# Altium schematic sheet FPGA_IOs.SchDoc (continued)
## Nets (continued)
CFG_DIFFI15_P: D2.G12(IO,_(DIFFIO_RX_T31p,_DIFFOUT_T31p,_DQ4T,_DQ2T)) ; port CFG_DIFF_I_BUS.CFG_DIFFI_p15
CFG_DIFFI16_N: D2.K8(IO,_(DIFFIO_RX_T33n,_DIFFOUT_T33n)) ; port CFG_DIFF_I_BUS.CFG_DIFFI_n16
CFG_DIFFI16_P: D2.K7(IO,_(DIFFIO_RX_T33p,_DIFFOUT_T33p)) ; port CFG_DIFF_I_BUS.CFG_DIFFI_p16
CFG_DIFFI17_N: D2.F10(IO,_(DIFFIO_RX_T35n,_DIFFOUT_T35n,_DQ5T,_DQ2T)) ; port CFG_DIFF_I_BUS.CFG_DIFFI_n17
CFG_DIFFI17_P: D2.G10(IO,_(DIFFIO_RX_T35p,_DIFFOUT_T35p,_DQ5T,_DQ2T)) ; port CFG_DIFF_I_BUS.CFG_DIFFI_p17
CFG_DIFFI18_N: D2.J9(IO,_(DIFFIO_RX_T37n,_DIFFOUT_T37n,_DQSn5T,_DQ2T)) ; port CFG_DIFF_I_BUS.CFG_DIFFI_n18
CFG_DIFFI18_P: D2.J10(IO,_(DIFFIO_RX_T37p,_DIFFOUT_T37p,_DQS5T,_DQ2T)) ; port CFG_DIFF_I_BUS.CFG_DIFFI_p18
CFG_DIFFI19_N: D2.F8(IO,_(DIFFIO_RX_T39n,_DIFFOUT_T39n,_DQ5T,_DQ2T)) ; port CFG_DIFF_I_BUS.CFG_DIFFI_n19
CFG_DIFFI19_P: D2.F9(IO,_(DIFFIO_RX_T39p,_DIFFOUT_T39p,_DQ5T,_DQ2T)) ; port CFG_DIFF_I_BUS.CFG_DIFFI_p19
CFG_DIFFI_CKI0_N: D2.G15(IO,_CLK7n,_(DIFFIO_RX_T1n,_DIFFOUT_T1n)) ; port CFG_DIFF_I_BUS.CFG_DIFFI_n0
CFG_DIFFI_CKI0_P: D2.H15(IO,_CLK7p,_(DIFFIO_RX_T1p,_DIFFOUT_T1p)) ; port CFG_DIFF_I_BUS.CFG_DIFFI_p0
CFG_DIFFI_CKI4_N: D2.J14(IO,_CLK6n,_FPLL_TL_FBn,_(DIFFIO_RX_T9n,_DIFFOUT_T9n)) ; port CFG_DIFF_I_BUS.CFG_DIFFI_n4
CFG_DIFFI_CKI4_P: D2.K14(IO,_CLK6p,_FPLL_TL_FBp,_(DIFFIO_RX_T9p,_DIFFOUT_T9p)) ; port CFG_DIFF_I_BUS.CFG_DIFFI_p4
CFG_DIFFO0_N: D2.A13(IO,_(DIFFIO_TX_T2n,_DIFFOUT_T2n,_DQ1T)) ; port CFG_DIFF_O_BUS.CFG_DIFFO_n0
CFG_DIFFO0_P: D2.B13(IO,_(DIFFIO_TX_T2p,_DIFFOUT_T2p,_DQ1T)) ; port CFG_DIFF_O_BUS.CFG_DIFFO_p0
CFG_DIFFO2_N: D2.B11(IO,_(DIFFIO_TX_T6n,_DIFFOUT_T6n,_DQ1T)) ; port CFG_DIFF_O_BUS.CFG_DIFFO_n2
CFG_DIFFO2_P: D2.C12(IO,_(DIFFIO_TX_T6p,_DIFFOUT_T6p)) ; port CFG_DIFF_O_BUS.CFG_DIFFO_p2
CFG_DIFFO3_N: D2.A8(IO,_(DIFFIO_TX_T8n,_DIFFOUT_T8n)) ; port CFG_DIFF_O_BUS.CFG_DIFFO_n3
CFG_DIFFO3_P: D2.A9(IO,_(DIFFIO_TX_T8p,_DIFFOUT_T8p,_DQ1T)) ; port CFG_DIFF_O_BUS.CFG_DIFFO_p3
CFG_DIFFO4_N: D2.B7(IO,_(DIFFIO_TX_T10n,_DIFFOUT_T10n,_DQ2T,_DQ1T)) ; port CFG_DIFF_O_BUS.CFG_DIFFO_n4
CFG_DIFFO4_P: D2.C7(IO,_(DIFFIO_TX_T10p,_DIFFOUT_T10p,_DQ2T,_DQ1T)) ; port CFG_DIFF_O_BUS.CFG_DIFFO_p4
CFG_DIFFO5_N: D2.B8(IO,_(DIFFIO_TX_T12n,_DIFFOUT_T12n,_DQ2T,_DQ1T)) ; port CFG_DIFF_O_BUS.CFG_DIFFO_n5
CFG_DIFFO5_P: D2.C8(IO,_(DIFFIO_TX_T12p,_DIFFOUT_T12p,_DQ2T,_DQ1T)) ; port CFG_DIFF_O_BUS.CFG_DIFFO_p5
CFG_DIFFO6_N: D2.C9(IO,_(DIFFIO_TX_T14n,_DIFFOUT_T14n,_DQ2T,_DQ1T)) ; port CFG_DIFF_O_BUS.CFG_DIFFO_n6
CFG_DIFFO6_P: D2.C10(IO,_(DIFFIO_TX_T14p,_DIFFOUT_T14p)) ; port CFG_DIFF_O_BUS.CFG_DIFFO_p6
CFG_DIFFO7_N: D2.A5(IO,_(DIFFIO_TX_T16n,_DIFFOUT_T16n)) ; port CFG_DIFF_O_BUS.CFG_DIFFO_n7
CFG_DIFFO7_P: D2.A6(IO,_(DIFFIO_TX_T16p,_DIFFOUT_T16p,_DQ2T,_DQ1T)) ; port CFG_DIFF_O_BUS.CFG_DIFFO_p7
CFG_DIFFO8_N: D2.A3(IO,_(DIFFIO_TX_T18n,_DIFFOUT_T18n,_DQ3T,_DQ1T)) ; port CFG_DIFF_O_BUS.CFG_DIFFO_n8
CFG_DIFFO8_P: D2.A4(IO,_(DIFFIO_TX_T18p,_DIFFOUT_T18p,_DQ3T,_DQ1T)) ; port CFG_DIFF_O_BUS.CFG_DIFFO_p8
CFG_DIFFO9_N: D2.C5(IO,_(DIFFIO_TX_T20n,_DIFFOUT_T20n,_DQ3T,_DQ1T)) ; port CFG_DIFF_O_BUS.CFG_DIFFO_n9
CFG_DIFFO9_P: D2.D6(IO,_(DIFFIO_TX_T20p,_DIFFOUT_T20p,_DQ3T,_DQ1T)) ; port CFG_DIFF_O_BUS.CFG_DIFFO_p9
CFG_DIFFO10_N: D2.C4(IO,_(DIFFIO_TX_T22n,_DIFFOUT_T22n,_DQ3T,_DQ1T)) ; port CFG_DIFF_O_BUS.CFG_DIFFO_n10
CFG_DIFFO10_P: D2.D5(IO,_(DIFFIO_TX_T22p,_DIFFOUT_T22p)) ; port CFG_DIFF_O_BUS.CFG_DIFFO_p10
CFG_DIFFO11_N: D2.D7(IO,_(DIFFIO_TX_T24n,_DIFFOUT_T24n)) ; port CFG_DIFF_O_BUS.CFG_DIFFO_n11
CFG_DIFFO11_P: D2.E8(IO,_(DIFFIO_TX_T24p,_DIFFOUT_T24p,_DQ3T,_DQ1T)) ; port CFG_DIFF_O_BUS.CFG_DIFFO_p11
CFG_DIFFO12_N: D2.B1(IO,_(DIFFIO_TX_T26n,_DIFFOUT_T26n,_DQ4T,_DQ2T)) ; port CFG_DIFF_O_BUS.CFG_DIFFO_n12
CFG_DIFFO12_P: D2.B2(IO,_(DIFFIO_TX_T26p,_DIFFOUT_T26p,_DQ4T,_DQ2T)) ; port CFG_DIFF_O_BUS.CFG_DIFFO_p12
CFG_DIFFO13_N: D2.B3(IO,_(DIFFIO_TX_T28n,_DIFFOUT_T28n,_DQ4T,_DQ2T)) ; port CFG_DIFF_O_BUS.CFG_DIFFO_n13
CFG_DIFFO13_P: D2.C3(IO,_(DIFFIO_TX_T28p,_DIFFOUT_T28p,_DQ4T,_DQ2T)) ; port CFG_DIFF_O_BUS.CFG_DIFFO_p13
CFG_DIFFO14_N: D2.C2(IO,_(DIFFIO_TX_T30n,_DIFFOUT_T30n,_DQ4T,_DQ2T)) ; port CFG_DIFF_O_BUS.CFG_DIFFO_n14
CFG_DIFFO14_P: D2.D2(IO,_(DIFFIO_TX_T30p,_DIFFOUT_T30p)) ; port CFG_DIFF_O_BUS.CFG_DIFFO_p14
CFG_DIFFO15_N: D2.D4(IO,_(DIFFIO_TX_T32n,_DIFFOUT_T32n)) ; port CFG_DIFF_O_BUS.CFG_DIFFO_n15
CFG_DIFFO15_P: D2.E4(IO,_(DIFFIO_TX_T32p,_DIFFOUT_T32p,_DQ4T,_DQ2T)) ; port CFG_DIFF_O_BUS.CFG_DIFFO_p15
CFG_DIFFO16_N: D2.E2(IO,_(DIFFIO_TX_T34n,_DIFFOUT_T34n,_DQ5T,_DQ2T)) ; port CFG_DIFF_O_BUS.CFG_DIFFO_n16
CFG_DIFFO16_P: D2.E3(IO,_(DIFFIO_TX_T34p,_DIFFOUT_T34p,_DQ5T,_DQ2T)) ; port CFG_DIFF_O_BUS.CFG_DIFFO_p16
CFG_DIFFO17_N: D2.D1(IO,_(DIFFIO_TX_T36n,_DIFFOUT_T36n,_DQ5T,_DQ2T)) ; port CFG_DIFF_O_BUS.CFG_DIFFO_n17
CFG_DIFFO17_P: D2.E1(IO,_(DIFFIO_TX_T36p,_DIFFOUT_T36p,_DQ5T,_DQ2T)) ; port CFG_DIFF_O_BUS.CFG_DIFFO_p17
CFG_DIFFO19_N: D2.F6(IO,_(DIFFIO_TX_T40n,_DIFFOUT_T40n)) ; port CFG_DIFF_O_BUS.CFG_DIFFO_n19
CFG_DIFFO19_P: D2.G7(IO,_(DIFFIO_TX_T40p,_DIFFOUT_T40p,_DQ5T,_DQ2T)) ; port CFG_DIFF_O_BUS.CFG_DIFFO_p19
CFG_DIFFO_CKO1_N: D2.A10(IO,_FPLL_TL_CLKOUT1,_FPLL_TL_CLKOUTn,_(DIFFIO_TX_T4n,_DIFFOUT_T4n,_DQ1T)) ; port CFG_DIFF_O_BUS.CFG_DIFFO_n1
CFG_DIFFO_CKO1_P: D2.A11(IO,_FPLL_TL_CLKOUT0,_FPLL_TL_CLKOUTp,_FPLL_TL_FB,_(DIFFIO_TX_T4p,_DIFFOUT_T4p,_DQ1T)) ; port CFG_DIFF_O_BUS.CFG_DIFFO_p1
CFG_DIFFO_CKO18_N: D2.E6(IO,_(DIFFIO_TX_T38n,_DIFFOUT_T38n,_DQ5T,_DQ2T)) ; port CFG_DIFF_O_BUS.CFG_DIFFO_n18
CFG_DIFFO_CKO18_P: D2.E7(IO,_(DIFFIO_TX_T38p,_DIFFOUT_T38p)) ; port CFG_DIFF_O_BUS.CFG_DIFFO_p18
EPCQ_CK: D2.U7(DCLK) D6.7(A6)
EPCQ_CK_: D6.14(B6) D7.6(C)
EPCQ_CS#: D2.AB8(nCSO,_DATA4) D6.6(A5)
EPCQ_CS#_: D6.15(B5) D7.1(S#)
EPCQ_D0: D2.AE6(AS_DATA0,_ASDO,_DATA0) D6.1(A1)
EPCQ_D0_: D6.20(B1) D7.5(DQ0)
EPCQ_D1: D2.AE5(AS_DATA1,_DATA1) D6.3(A2)
EPCQ_D1_: D6.18(B2) D7.7(HOLD#/DQ3)
EPCQ_D2: D2.AE8(AS_DATA2,_DATA2) D6.4(A3)
EPCQ_D2_: D6.17(B3) D7.3(W#/DQ2)
EPCQ_D3: D2.AC7(AS_DATA3,_DATA3) D6.5(A4)
EPCQ_D3_: D6.16(B4) D7.2(DQ1)
FPGA_CFG2V5_IO_0: D2.AB30(IO,_(DIFFIO_RX_R19p,_DIFFOUT_R19p,_DQ3R)) ; port MIPI_CLK24.MIPI_CSI_24CLKA_2v5
FPGA_CFG2V5_IO_1: D2.AA30(IO,_(DIFFIO_RX_R19n,_DIFFOUT_R19n,_DQ3R)) ; port 3v3_IOBUF_EN
FPGA_CFG2V5_IO_2: D2.AG27(IO,_RZQ_1,_(DIFFIO_TX_R1p,_DIFFOUT_R1p,_DQ1R)) ; port CFG_2v5IO_A.FPGA_GPIO2V5_0
FPGA_CFG2V5_IO_3: D2.AH28(IO,_PR_REQUEST,_(DIFFIO_TX_R1n,_DIFFOUT_R1n,_DQ1R)) ; port CFG_2v5IO_A.FPGA_GPIO2V5_1
FPGA_CFG2V5_IO_4: D2.AG28(IO,_(DIFFIO_TX_R12p,_DIFFOUT_R12p,_DQ2R)) ; port CFG_2v5IO_A.FPGA_GPIO2V5_2
FPGA_CFG2V5_IO_5: D2.AF28(IO,_(DIFFIO_TX_R12n,_DIFFOUT_R12n,_DQ2R)) ; port CFG_2v5IO_A.FPGA_GPIO2V5_3
FPGA_CFG2V5_IO_6: D2.AF29(IO,_(DIFFIO_TX_R14p,_DIFFOUT_R14p)) ; port CFG_2v5IO_A.FPGA_GPIO2V5_4
FPGA_CFG2V5_IO_7: D2.AF30(IO,_(DIFFIO_TX_R14n,_DIFFOUT_R14n,_DQ2R)) ; port CFG_2v5IO_A.FPGA_GPIO2V5_5
FPGA_CFG2V5_IO_8: D2.AH30(IO,_(DIFFIO_TX_R16p,_DIFFOUT_R16p,_DQ2R)) ; port CFG_2v5IO_A.FPGA_GPIO2V5_6
FPGA_CFG2V5_IO_9: D2.AG30(IO,_(DIFFIO_TX_R16n,_DIFFOUT_R16n)) ; port CFG_2v5IO_A.FPGA_GPIO2V5_7
FPGA_CFG2V5_IO_10: D2.AC28(IO,_(DIFFIO_TX_R18p,_DIFFOUT_R18p,_DQ3R)) ; port CFG_2v5IO_A.FPGA_GPIO2V5_8
FPGA_CFG2V5_IO_11: D2.AC29(IO,_(DIFFIO_TX_R18n,_DIFFOUT_R18n,_DQ3R)) ; port CFG_2v5IO_A.FPGA_GPIO2V5_9
FPGA_CFG2V5_IO_12: D2.AB28(IO,_(DIFFIO_TX_R20p,_DIFFOUT_R20p,_DQ3R)) ; port CFG_2v5IO_A.FPGA_GPIO2V5_10
FPGA_CFG2V5_IO_13: D2.AA28(IO,_(DIFFIO_TX_R20n,_DIFFOUT_R20n,_DQ3R)) ; port CFG_2v5IO_A.FPGA_GPIO2V5_11
FPGA_CFG2V5_IO_14: D2.AD30(IO,_(DIFFIO_TX_R24p,_DIFFOUT_R24p,_DQ3R)) ; port CFG_2v5IO_A.FPGA_GPIO2V5_12
FPGA_CFG2V5_IO_15: D2.AC30(IO,_RZQ_2,_(DIFFIO_TX_R24n,_DIFFOUT_R24n)) ; port CFG_2v5IO_A.FPGA_GPIO2V5_13
FPGA_CFG2V5_IO_16: D2.AA12(IO,_(DIFFIO_RX_B11p,_DIFFOUT_B11p,_DQS2B)) ; port MIPI_CLK24.MIPI_CSI_24CLKB_2v5
FPGA_CFG2V5_IO_17: D2.AB12(IO,_(DIFFIO_RX_B11n,_DIFFOUT_B11n,_DQSn2B)) ; port CFG_2v5IO_C.FPGA_CFG2V5_IO_33
FPGA_CFG2V5_IO_18: D2.AJ1(IO,_(DIFFIO_RX_B14p,_DIFFOUT_B14p,_DQ2B)) ; port CFG_2v5IO_A.FPGA_GPIO2V5_14
FPGA_CFG2V5_IO_19: D2.AJ2(IO,_(DIFFIO_RX_B14n,_DIFFOUT_B14n,_DQ2B)) ; port CFG_2v5IO_A.FPGA_GPIO2V5_15
FPGA_CFG2V5_IO_20: D2.AD9(IO,_DATA7,_(DIFFIO_TX_B2p,_DIFFOUT_B2p,_DQ1B)) ; port CFG_2v5IO_C.FPGA_CFG2V5_IO_34
FPGA_CFG2V5_IO_21: D2.AE9(IO,_DATA5,_(DIFFIO_TX_B2n,_DIFFOUT_B2n)) ; port CFG_2v5IO_C.FPGA_CFG2V5_IO_35
FPGA_CFG2V5_IO_22: D2.AE11(IO,_DATA11,_(DIFFIO_TX_B4p,_DIFFOUT_B4p)) ; port CFG_2v5IO_B.FPGA_CFG2V5_IO_16
FPGA_CFG2V5_IO_23: D2.AF10(IO,_DATA9,_(DIFFIO_TX_B4n,_DIFFOUT_B4n,_DQ1B)) ; port CFG_2v5IO_B.FPGA_CFG2V5_IO_17
FPGA_CFG2V5_IO_24: D2.AG3(IO,_DATA15,_(DIFFIO_TX_B6p,_DIFFOUT_B6p,_DQ1B)) ; port CFG_2v5IO_B.FPGA_CFG2V5_IO_18
FPGA_CFG2V5_IO_25: D2.AH4(IO,_DATA13,_(DIFFIO_TX_B6n,_DIFFOUT_B6n,_DQ1B)) ; port CFG_2v5IO_B.FPGA_CFG2V5_IO_19
FPGA_CFG2V5_IO_26: D2.AF9(IO,_(DIFFIO_TX_B8p,_DIFFOUT_B8p,_DQ1B)) ; port CFG_2v5IO_B.FPGA_CFG2V5_IO_20
FPGA_CFG2V5_IO_27: D2.AG8(IO,_PR_READY,_(DIFFIO_TX_B8n,_DIFFOUT_B8n,_DQ1B)) ; port CFG_2v5IO_B.FPGA_CFG2V5_IO_21
FPGA_CFG2V5_IO_28: D2.AF8(IO,_(DIFFIO_TX_B9p,_DIFFOUT_B9p,_DQ2B)) ; port CFG_2v5IO_B.FPGA_CFG2V5_IO_22
FPGA_CFG2V5_IO_29: D2.AG7(IO,_(DIFFIO_TX_B9n,_DIFFOUT_B9n)) ; port CFG_2v5IO_B.FPGA_CFG2V5_IO_23
FPGA_CFG2V5_IO_30: D2.AF6(IO,_(DIFFIO_TX_B12p,_DIFFOUT_B12p)) ; port CFG_2v5IO_B.FPGA_CFG2V5_IO_24
FPGA_CFG2V5_IO_31: D2.AG6(IO,_(DIFFIO_TX_B12n,_DIFFOUT_B12n,_DQ2B)) ; port CFG_2v5IO_B.FPGA_CFG2V5_IO_25
FPGA_CFG2V5_IO_32: D2.AG5(IO,_(DIFFIO_TX_B13p,_DIFFOUT_B13p,_DQ2B)) ; port CFG_2v5IO_B.FPGA_CFG2V5_IO_26
FPGA_CFG2V5_IO_33: D2.AH5(IO,_(DIFFIO_TX_B13n,_DIFFOUT_B13n,_DQ2B)) ; port CFG_2v5IO_B.FPGA_CFG2V5_IO_27
FPGA_CFG2V5_IO_34: D2.AC12(IO,_(DIFFIO_RX_B15p,_DIFFOUT_B15p)) ; port CFG_2v5IO_B.FPGA_CFG2V5_IO_28
FPGA_CFG2V5_IO_35: D2.AD12(IO,_(DIFFIO_RX_B15n,_DIFFOUT_B15n)) ; port CFG_2v5IO_B.FPGA_CFG2V5_IO_29
FPGA_CFG2V5_IO_36: D2.AG2(IO,_(DIFFIO_TX_B16p,_DIFFOUT_B16p,_DQ2B)) ; port CFG_2v5IO_B.FPGA_CFG2V5_IO_30
FPGA_CFG2V5_IO_37: D2.AH3(IO,_(DIFFIO_TX_B16n,_DIFFOUT_B16n,_DQ2B)) ; port CFG_2v5IO_B.FPGA_CFG2V5_IO_31
FPGA_CONF#: D2.J5(nCONFIG) ; port FPGA_CNF.FPGA_CONF#
FPGA_CONFDONE: D2.F3(CONF_DONE) ; port FPGA_CNF.FPGA_CONFDONE
FPGA_STATUS#: D2.F4(nSTATUS) ; port FPGA_CNF.FPGA_STATUS#
GXB_REF_CK0_N: D2.W7(REFCLK0Ln) ; port GXB_CLKin_0.GXB_ref_clki0_n
GXB_REF_CK0_P: D2.W8(REFCLK0Lp) ; port GXB_CLKin_0.GXB_ref_clki0_p
GXB_REF_CK1_N: D2.T8(REFCLK1Ln) ; port GXB_CLKin_1.GXB_ref_clki1_n
GXB_REF_CK1_P: D2.T9(REFCLK1Lp) ; port GXB_CLKin_1.GXB_ref_clki1_p
GXB_RXA0_N: D2.AC1(GXB_RX_L1n,_GXB_REFCLK_L1n) ; port GXB_Rx_bus_x8.GXB_RX_0n
GXB_RXA0_P: D2.AC2(GXB_RX_L1p,_GXB_REFCLK_L1p) ; port GXB_Rx_bus_x8.GXB_RX_0p
GXB_RXA1_N: D2.AA1(GXB_RX_L2n,_GXB_REFCLK_L2n) ; port GXB_Rx_bus_x8.GXB_RX_1n
GXB_RXA1_P: D2.AA2(GXB_RX_L2p,_GXB_REFCLK_L2p) ; port GXB_Rx_bus_x8.GXB_RX_1p
GXB_RXA2_N: D2.W1(GXB_RX_L3n,_GXB_REFCLK_L3n) ; port GXB_Rx_bus_x8.GXB_RX_2n
GXB_RXA2_P: D2.W2(GXB_RX_L3p,_GXB_REFCLK_L3p) ; port GXB_Rx_bus_x8.GXB_RX_2p
GXB_RXA3_N: D2.U1(GXB_RX_L4n,_GXB_REFCLK_L4n) ; port GXB_Rx_bus_x8.GXB_RX_3n
GXB_RXA3_P: D2.U2(GXB_RX_L4p,_GXB_REFCLK_L4p) ; port GXB_Rx_bus_x8.GXB_RX_3p
GXB_RXA4_N: D2.R1(GXB_RX_L5n,_GXB_REFCLK_L5n) ; port GXB_Rx_bus_x8.GXB_RX_4n
GXB_RXA4_P: D2.R2(GXB_RX_L5p,_GXB_REFCLK_L5p) ; port GXB_Rx_bus_x8.GXB_RX_4p
GXB_RXA5_N: D2.N1(GXB_RX_L6n,_GXB_REFCLK_L6n) ; port GXB_Rx_bus_x8.GXB_RX_5n
GXB_RXA5_P: D2.N2(GXB_RX_L6p,_GXB_REFCLK_L6p) ; port GXB_Rx_bus_x8.GXB_RX_5p
GXB_RXA6_N: D2.L1(GXB_RX_L7n,_GXB_REFCLK_L7n) ; port GXB_Rx_bus_x8.GXB_RX_6n
GXB_RXA6_P: D2.L2(GXB_RX_L7p,_GXB_REFCLK_L7p) ; port GXB_Rx_bus_x8.GXB_RX_6p
GXB_RXA7_N: D2.J1(GXB_RX_L8n,_GXB_REFCLK_L8n) ; port GXB_Rx_bus_x8.GXB_RX_7n
GXB_RXA7_P: D2.J2(GXB_RX_L8p,_GXB_REFCLK_L8p) ; port GXB_Rx_bus_x8.GXB_RX_7p
GXB_RXB0_N: D2.AE1(GXB_RX_L0n,_GXB_REFCLK_L0n) ; port GXB_Rx_bus_x1.GXB_RX_0n
GXB_RXB0_P: D2.AE2(GXB_RX_L0p,_GXB_REFCLK_L0p) ; port GXB_Rx_bus_x1.GXB_RX_0p
GXB_TXA0_N: C25.2(-) ; port GXB_Tx_bus_x8.GXB_TX_0n
GXB_TXA0_P: C24.2(-) ; port GXB_Tx_bus_x8.GXB_TX_0p
GXB_TXA1_N: C27.2(-) ; port GXB_Tx_bus_x8.GXB_TX_1n
GXB_TXA1_P: C26.2(-) ; port GXB_Tx_bus_x8.GXB_TX_1p
GXB_TXA2_N: C29.2(-) ; port GXB_Tx_bus_x8.GXB_TX_2n
GXB_TXA2_P: C28.2(-) ; port GXB_Tx_bus_x8.GXB_TX_2p
GXB_TXA3_N: C31.2(-) ; port GXB_Tx_bus_x8.GXB_TX_3n
GXB_TXA3_P: C30.2(-) ; port GXB_Tx_bus_x8.GXB_TX_3p
GXB_TXA4_N: C33.2(-) ; port GXB_Tx_bus_x8.GXB_TX_4n
GXB_TXA4_P: C32.2(-) ; port GXB_Tx_bus_x8.GXB_TX_4p
GXB_TXA5_N: C37.2(-) ; port GXB_Tx_bus_x8.GXB_TX_5n
GXB_TXA5_P: C36.2(-) ; port GXB_Tx_bus_x8.GXB_TX_5p
GXB_TXA6_N: C39.2(-) ; port GXB_Tx_bus_x8.GXB_TX_6n
GXB_TXA6_P: C38.2(-) ; port GXB_Tx_bus_x8.GXB_TX_6p
GXB_TXA7_N: C41.2(-) ; port GXB_Tx_bus_x8.GXB_TX_7n
GXB_TXA7_P: C40.2(-) ; port GXB_Tx_bus_x8.GXB_TX_7p
GXB_TXA_C0_N: C25.1(+) D2.AB3(GXB_TX_L1n)
GXB_TXA_C0_P: C24.1(+) D2.AB4(GXB_TX_L1p)
GXB_TXA_C1_N: C27.1(+) D2.Y3(GXB_TX_L2n)
GXB_TXA_C1_P: C26.1(+) D2.Y4(GXB_TX_L2p)
GXB_TXA_C2_N: C29.1(+) D2.V3(GXB_TX_L3n)
GXB_TXA_C2_P: C28.1(+) D2.V4(GXB_TX_L3p)
GXB_TXA_C3_N: C31.1(+) D2.T3(GXB_TX_L4n)
GXB_TXA_C3_P: C30.1(+) D2.T4(GXB_TX_L4p)
GXB_TXA_C4_N: C33.1(+) D2.P3(GXB_TX_L5n)
GXB_TXA_C4_P: C32.1(+) D2.P4(GXB_TX_L5p)
GXB_TXA_C5_N: C37.1(+) D2.M3(GXB_TX_L6n)
GXB_TXA_C5_P: C36.1(+) D2.M4(GXB_TX_L6p)
GXB_TXA_C6_N: C39.1(+) D2.K3(GXB_TX_L7n)
GXB_TXA_C6_P: C38.1(+) D2.K4(GXB_TX_L7p)
GXB_TXA_C7_N: C41.1(+) D2.H3(GXB_TX_L8n)
GXB_TXA_C7_P: C40.1(+) D2.H4(GXB_TX_L8p)
GXB_TXB0_N: C23.2(-) ; port GXB_Tx_bus_x1.GXB_TX_0n
GXB_TXB0_P: C22.2(-) ; port GXB_Tx_bus_x1.GXB_TX_0p
GXB_TXB_C0_N: C23.1(+) D2.AD3(GXB_TX_L0n)
GXB_TXB_C0_P: C22.1(+) D2.AD4(GXB_TX_L0p)
LVDS0_CKO_N: D2.AD29(IO,_FPLL_BR_CLKOUT1,_FPLL_BR_CLKOUTn,_(DIFFIO_TX_R22n,_DIFFOUT_R22n,_DQ3R)) ; port LVDS_VO_0.LVDS0_CKO_N
LVDS0_CKO_P: D2.AE29(IO,_FPLL_BR_CLKOUT0,_FPLL_BR_CLKOUTp,_FPLL_BR_FB,_(DIFFIO_TX_R22p,_DIFFOUT_R22p)) ; port LVDS_VO_0.LVDS0_CKO_P
LVDS0_TX0_N: D2.AH29(IO,_CvP_CONFDONE,_(DIFFIO_TX_R3n,_DIFFOUT_R3n,_DQ1R)) ; port LVDS_VO_0.LVDS0_TX0_N
LVDS0_TX0_P: D2.AJ29(IO,_nCEO,_(DIFFIO_TX_R3p,_DIFFOUT_R3p,_DQ1R)) ; port LVDS_VO_0.LVDS0_TX0_P
LVDS0_TX1_N: D2.AD27(IO,_DEV_CLRn,_(DIFFIO_TX_R5n,_DIFFOUT_R5n,_DQ1R)) ; port LVDS_VO_0.LVDS0_TX1_N
LVDS0_TX1_P: D2.AE26(IO,_DEV_OE,_(DIFFIO_TX_R5p,_DIFFOUT_R5p)) ; port LVDS_VO_0.LVDS0_TX1_P
LVDS0_TX2_N: D2.AB26(IO,_(DIFFIO_TX_R7n,_DIFFOUT_R7n)) ; port LVDS_VO_0.LVDS0_TX2_N
LVDS0_TX2_P: D2.AA25(IO,_(DIFFIO_TX_R7p,_DIFFOUT_R7p,_DQ1R)) ; port LVDS_VO_0.LVDS0_TX2_P
LVDS0_TX3_N: D2.AE28(IO,_(DIFFIO_TX_R10n,_DIFFOUT_R10n,_DQ2R)) ; port LVDS_VO_0.LVDS0_TX3_N
LVDS0_TX3_P: D2.AE27(IO,_(DIFFIO_TX_R10p,_DIFFOUT_R10p,_DQ2R)) ; port LVDS_VO_0.LVDS0_TX3_P
MIPI_CSI_CKA_HS_N: D2.Y27(IO,_CLK4n,_FPLL_BR_FBn,_(DIFFIO_RX_R23n,_DIFFOUT_R23n,_DQ3R)) ; port MIPI_CSI-2_A_HS.MIPI_CSI_CKA_HS_N
MIPI_CSI_CKA_HS_P: D2.Y26(IO,_CLK4p,_FPLL_BR_FBp,_(DIFFIO_RX_R23p,_DIFFOUT_R23p,_DQ3R)) ; port MIPI_CSI-2_A_HS.MIPI_CSI_CKA_HS_P
MIPI_CSI_CKA_LP_N: D2.V25(IO,_(DIFFIO_RX_R17n,_DIFFOUT_R17n)) ; port MIPI_CSI-2_A_LP.MIPI_CSI_CKA_LP_N
MIPI_CSI_CKA_LP_P: D2.W25(IO,_(DIFFIO_RX_R17p,_DIFFOUT_R17p)) ; port MIPI_CSI-2_A_LP.MIPI_CSI_CKA_LP_P
MIPI_CSI_CKB_LP_N: D2.AH2(IO,_(DIFFIO_RX_B10n,_DIFFOUT_B10n,_DQ2B)) ; port MIPI_CSI-2_B_LP.MIPI_CSI_CKB_LP_N
MIPI_CSI_CKB_LP_P: D2.AG1(IO,_(DIFFIO_RX_B10p,_DIFFOUT_B10p,_DQ2B)) ; port MIPI_CSI-2_B_LP.MIPI_CSI_CKB_LP_P
MIPI_CSI_DA0_HS_N: D2.AC25(IO,_CRC_ERROR,_(DIFFIO_RX_R2n,_DIFFOUT_R2n)) ; port MIPI_CSI-2_A_HS.MIPI_CSI_DA0_HS_N
MIPI_CSI_DA0_HS_P: D2.AD25(IO,_INIT_DONE,_(DIFFIO_RX_R2p,_DIFFOUT_R2p)) ; port MIPI_CSI-2_A_HS.MIPI_CSI_DA0_HS_P
MIPI_CSI_DA0_LP_N: D2.AB25(IO,_(DIFFIO_RX_R9n,_DIFFOUT_R9n)) ; port MIPI_CSI-2_A_LP.MIPI_CSI_DA0_LP_N
MIPI_CSI_DA0_LP_P: D2.AA24(IO,_(DIFFIO_RX_R9p,_DIFFOUT_R9p)) ; port MIPI_CSI-2_A_LP.MIPI_CSI_DA0_LP_P
MIPI_CSI_DA1_HS_N: D2.Y21(IO,_(DIFFIO_RX_R4n,_DIFFOUT_R4n,_DQ1R)) ; port MIPI_CSI-2_A_HS.MIPI_CSI_DA1_HS_N
MIPI_CSI_DA1_HS_P: D2.W20(IO,_(DIFFIO_RX_R4p,_DIFFOUT_R4p,_DQ1R)) ; port MIPI_CSI-2_A_HS.MIPI_CSI_DA1_HS_P
MIPI_CSI_DA1_LP_N: D2.Y24(IO,_(DIFFIO_RX_R11n,_DIFFOUT_R11n,_DQ2R)) ; port MIPI_CSI-2_A_LP.MIPI_CSI_DA1_LP_N
MIPI_CSI_DA1_LP_P: D2.Y23(IO,_(DIFFIO_RX_R11p,_DIFFOUT_R11p,_DQ2R)) ; port MIPI_CSI-2_A_LP.MIPI_CSI_DA1_LP_P
MIPI_CSI_DA2_HS_N: D2.W22(IO,_nPERSTL1,_(DIFFIO_RX_R6n,_DIFFOUT_R6n,_DQSn1R)) ; port MIPI_CSI-2_A_HS.MIPI_CSI_DA2_HS_N
MIPI_CSI_DA2_HS_P: D2.W21(IO,_nPERSTL0,_(DIFFIO_RX_R6p,_DIFFOUT_R6p,_DQS1R)) ; port MIPI_CSI-2_A_HS.MIPI_CSI_DA2_HS_P
MIPI_CSI_DA2_LP_N: D2.W24(IO,_(DIFFIO_RX_R13n,_DIFFOUT_R13n,_DQSn2R)) ; port MIPI_CSI-2_A_LP.MIPI_CSI_DA2_LP_N
MIPI_CSI_DA2_LP_P: D2.V23(IO,_(DIFFIO_RX_R13p,_DIFFOUT_R13p,_DQS2R)) ; port MIPI_CSI-2_A_LP.MIPI_CSI_DA2_LP_P
MIPI_CSI_DA3_HS_N: D2.AB23(IO,_(DIFFIO_RX_R8n,_DIFFOUT_R8n,_DQ1R)) ; port MIPI_CSI-2_A_HS.MIPI_CSI_DA3_HS_N
MIPI_CSI_DA3_HS_P: D2.AB22(IO,_(DIFFIO_RX_R8p,_DIFFOUT_R8p,_DQ1R)) ; port MIPI_CSI-2_A_HS.MIPI_CSI_DA3_HS_P
MIPI_CSI_DA3_LP_N: D2.AC27(IO,_(DIFFIO_RX_R15n,_DIFFOUT_R15n,_DQ2R)) ; port MIPI_CSI-2_A_LP.MIPI_CSI_DA3_LP_N
MIPI_CSI_DA3_LP_P: D2.AD26(IO,_(DIFFIO_RX_R15p,_DIFFOUT_R15p,_DQ2R)) ; port MIPI_CSI-2_A_LP.MIPI_CSI_DA3_LP_P
MIPI_CSI_DB0_LP_N: D2.AE12(IO,_DATA6,_(DIFFIO_RX_B1n,_DIFFOUT_B1n,_DQ1B)) ; port MIPI_CSI-2_B_LP.MIPI_CSI_DB0_LP_N
MIPI_CSI_DB0_LP_P: D2.AD11(IO,_DATA8,_(DIFFIO_RX_B1p,_DIFFOUT_B1p,_DQ1B)) ; port MIPI_CSI-2_B_LP.MIPI_CSI_DB0_LP_P
MIPI_CSI_DB1_LP_N: D2.AD10(IO,_DATA10,_(DIFFIO_RX_B3n,_DIFFOUT_B3n,_DQSn1B)) ; port MIPI_CSI-2_B_LP.MIPI_CSI_DB1_LP_N
MIPI_CSI_DB1_LP_P: D2.AC9(IO,_DATA12,_(DIFFIO_RX_B3p,_DIFFOUT_B3p,_DQS1B)) ; port MIPI_CSI-2_B_LP.MIPI_CSI_DB1_LP_P
MIPI_CSI_DB2_LP_N: D2.AE7(IO,_DATA14,_(DIFFIO_RX_B5n,_DIFFOUT_B5n,_DQ1B)) ; port MIPI_CSI-2_B_LP.MIPI_CSI_DB2_LP_N
MIPI_CSI_DB2_LP_P: D2.AD7(IO,_CLKUSR,_(DIFFIO_RX_B5p,_DIFFOUT_B5p,_DQ1B)) ; port MIPI_CSI-2_B_LP.MIPI_CSI_DB2_LP_P
MIPI_CSI_DB3_LP_N: D2.AF5(IO,_PR_DONE,_(DIFFIO_RX_B7n,_DIFFOUT_B7n)) ; port MIPI_CSI-2_B_LP.MIPI_CSI_DB3_LP_N
MIPI_CSI_DB3_LP_P: D2.AF4(IO,_PR_ERROR,_(DIFFIO_RX_B7p,_DIFFOUT_B7p)) ; port MIPI_CSI-2_B_LP.MIPI_CSI_DB3_LP_P
MSEL0: D2.L8(MSEL0) ; port FPGA_MSEL.FPGA_MSEL0
MSEL1: D2.K6(MSEL1) ; port FPGA_MSEL.FPGA_MSEL1
MSEL2: D2.G6(MSEL2) ; port FPGA_MSEL.FPGA_MSEL2
MSEL3: D2.L7(MSEL3) ; port FPGA_MSEL.FPGA_MSEL3
MSEL4: D2.L9(MSEL4) ; port FPGA_MSEL.FPGA_MSEL4
OSC_50_3: C21.1(+) ; port OSC_50_3
OSC_50_B5A5B: C21.2(-) D2.AA26(IO,_CLK5p,_(DIFFIO_RX_R21p,_DIFFOUT_R21p,_DQS3R)) R60.1(+) R61.1(+)
TCK: D2.AC5(TCK) ; port FPGA_JTAG.FPGA_JTAG_TCK
TDI: D2.U8(TDI) ; port FPGA_JTAG.FPGA_JTAG_TDI
TDO: D2.AB9(TDO) ; port FPGA_JTAG.FPGA_JTAG_TDO
TMS: D2.V9(TMS) ; port FPGA_JTAG.FPGA_JTAG_TMS
NetD2_P8: D2.P8(REFCLK2Ln) D2.P9(REFCLK2Lp) R62.2(-)
NetD6_10: D6.10(OE) R63.2(-)

Not connected (* = marked no-connect by the designer): D6 8(A7)* 9(A8)* 12(B8)* 13(B7)*

## Layout directives
differential pair: (no net found under the mark), CFG_DIFFI1_N, CFG_DIFFI1_P, CFG_DIFFI2_N, CFG_DIFFI2_P, CFG_DIFFI3_N, CFG_DIFFI3_P, CFG_DIFFI5_N, CFG_DIFFI5_P, CFG_DIFFI6_N, CFG_DIFFI6_P, CFG_DIFFI7_N, CFG_DIFFI7_P, CFG_DIFFI8_N, CFG_DIFFI8_P, CFG_DIFFI9_N, CFG_DIFFI9_P, CFG_DIFFI10_N, CFG_DIFFI10_P, CFG_DIFFI11_N, CFG_DIFFI11_P, CFG_DIFFI12_N, CFG_DIFFI12_P, CFG_DIFFI13_N, CFG_DIFFI13_P, CFG_DIFFI14_N, CFG_DIFFI14_P, CFG_DIFFI15_N, CFG_DIFFI15_P, CFG_DIFFI16_N, CFG_DIFFI16_P, CFG_DIFFI17_N, CFG_DIFFI17_P, CFG_DIFFI18_N, CFG_DIFFI18_P, CFG_DIFFI19_N, CFG_DIFFI19_P, CFG_DIFFI_CKI0_N, CFG_DIFFI_CKI0_P, CFG_DIFFI_CKI4_N, CFG_DIFFI_CKI4_P, CFG_DIFFO0_N, CFG_DIFFO0_P, CFG_DIFFO2_N, CFG_DIFFO2_P, CFG_DIFFO3_N, CFG_DIFFO3_P, CFG_DIFFO4_N, CFG_DIFFO4_P, CFG_DIFFO5_N, CFG_DIFFO5_P, CFG_DIFFO6_N, CFG_DIFFO6_P, CFG_DIFFO7_N, CFG_DIFFO7_P, CFG_DIFFO8_N, CFG_DIFFO8_P, CFG_DIFFO9_N, CFG_DIFFO9_P, CFG_DIFFO10_N, CFG_DIFFO10_P, CFG_DIFFO11_N, CFG_DIFFO11_P, CFG_DIFFO12_N, CFG_DIFFO12_P, CFG_DIFFO13_N, CFG_DIFFO13_P, CFG_DIFFO14_N, CFG_DIFFO14_P, CFG_DIFFO15_N, CFG_DIFFO15_P, CFG_DIFFO16_N, CFG_DIFFO16_P, CFG_DIFFO17_N, CFG_DIFFO17_P, CFG_DIFFO19_N, CFG_DIFFO19_P, CFG_DIFFO_CKO1_N, CFG_DIFFO_CKO1_P, CFG_DIFFO_CKO18_N, CFG_DIFFO_CKO18_P, GXB_REF_CK0_N, GXB_REF_CK0_P, GXB_REF_CK1_N, GXB_REF_CK1_P, GXB_RXA0_N, GXB_RXA0_P, GXB_RXA1_N, GXB_RXA1_P, GXB_RXA2_N, GXB_RXA2_P, GXB_RXA3_N, GXB_RXA3_P, GXB_RXA4_N, GXB_RXA4_P, GXB_RXA5_N, GXB_RXA5_P, GXB_RXA6_N, GXB_RXA6_P, GXB_RXA7_N, GXB_RXA7_P, GXB_RXB0_N, GXB_RXB0_P, GXB_TXA0_N, GXB_TXA0_P, GXB_TXA1_N, GXB_TXA1_P, GXB_TXA2_N, GXB_TXA2_P, GXB_TXA3_N, GXB_TXA3_P, GXB_TXA4_N, GXB_TXA4_P, GXB_TXA5_N, GXB_TXA5_P, GXB_TXA6_N, GXB_TXA6_P, GXB_TXA7_N, GXB_TXA7_P, GXB_TXA_C0_N, GXB_TXA_C0_P, GXB_TXA_C1_N, GXB_TXA_C1_P, GXB_TXA_C2_N, GXB_TXA_C2_P, GXB_TXA_C3_N, GXB_TXA_C3_P, GXB_TXA_C4_N, GXB_TXA_C4_P, GXB_TXA_C5_N, GXB_TXA_C5_P, GXB_TXA_C6_N, GXB_TXA_C6_P, GXB_TXA_C7_N, GXB_TXA_C7_P, GXB_TXB0_N, GXB_TXB0_P, GXB_TXB_C0_N, GXB_TXB_C0_P, LVDS0_CKO_N, LVDS0_CKO_P, LVDS0_TX0_N, LVDS0_TX0_P, LVDS0_TX1_N, LVDS0_TX1_P, LVDS0_TX2_N, LVDS0_TX2_P, LVDS0_TX3_N, LVDS0_TX3_P, MIPI_CSI_CKA_HS_N, MIPI_CSI_CKA_HS_P, MIPI_CSI_DA0_HS_N, MIPI_CSI_DA0_HS_P, MIPI_CSI_DA1_HS_N, MIPI_CSI_DA1_HS_P, MIPI_CSI_DA2_HS_N, MIPI_CSI_DA2_HS_P, MIPI_CSI_DA3_HS_N, MIPI_CSI_DA3_HS_P

## Notes on the sheet
- Form connector B
- To connector B
- (near D2) VCCIO=2.5V
- (near D2) VCCIO=1.8/2.5/3.3V
- (near D2) VCCIO=2.5/3.3V
- Form connector C
- To connector C
- (near D2) VCCPGM=2.5V
- (in symbol 5CSXFC6D6F31I7N, part A) BANK 3A
- (in symbol 5CSXFC6D6F31I7N, part D) BANK 5A
- (in symbol 5CSXFC6D6F31I7N, part E) BANK 5B
- (in symbol 5CSXFC6D6F31I7N, part L) BANK 8A
- (in symbol 5CSXFC6D6F31I7N, part R) BANK 3A; BANK 9A
- (in symbol CR0402-#-±5%) 0402

## Library data of the parts
C21-C42 = CC0402-X7R-#-20%-10В: Чип конденсатор керамический; Supplier 1: Digi-Key; Supplier Part Number 1: 399-3520-1-ND
D2 = 5CSXFC6D6F31I7N: Cyclone V SX Family FPGA, 1.07 to 1.13 V Supply, 288 I/O Pins, 6 PLLs, 896-Pin FBGA, Speed Grade 7, Industrial Grade, RoHS Compliant; Manufacturer: Altera; Logic Elements (LE) (K): 110; Speed Grade: 7; DatasheetVersion: Rev. 3.4; PackageVersion: Rev. 2.0, 12/2012; PackageReference: FBGA896_A-200; PackageDescription: 896-Pin FineLine Ball-Grid Array (FBGA), Body 31 x 31 mm, Pitch 1 mm; Supplier 1: Digi-Key; Supplier Part Number 1: 5CSXFC6D6F31I7N-ND; Supplier 2: Mouser; Supplier Part Number 2: 989-5CSXFC6D6F31I7N; Device Group: 5CSXFC6; RoHS: RoHS Compliant; Subcategory: Cyclone V SX; Voltage Supply: 1.07 to 1.13 V; NexusDeviceID: 5CSXFC6D6F31I7N; Mounting Technology: Surface Mount; Code_JEDEC: MS-034; PartNumber: 5CSXFC6D6F31I7N; ComponentLink1Description: Manufacturer URL; ComponentLink1URL: http://www.altera.com; ComponentLink2Description: Datasheet; ComponentLink2URL: http://www.altera.com/literature/hb/cyclone-v/cv_51002.pdf; ComponentLink3Description: Package Specification; ComponentLink3URL: http://www.altera.com/devicepackaging/04R00435-01.pdf; ComponentLink4Description: Device Handbook URL; ComponentLink4URL: http://www.altera.com/literature/hb/cyclone-v/cyclone5_handbook.pdf; ComponentLink5Description: Device Pin-Out URL; ComponentLink5URL: http://www.altera.com/literature/dp/cyclone-v/5CSXFC6.xls; ComponentLink6Description: Product URL; ComponentLink6URL: http://www.buyaltera.com/scripts/partsearch.dll?Detail&name=5CSXFC6D6F31I7N-ND
D6 = TXS0108ERGYR: 8-Bit Bidirectional Voltage-Level Translator with Auto Direction Sensing and +/-15-kV ESD Protect, VQFN-20 LARGE T&R; Generic Part Number: TXB0108; Manufacturer: Texas Instruments; VCC(Min)(V): 1.2; VCC(Max)(V): 5.5; Output Type: CMOS; Logic: True; ICC @ Nom Voltage(Max)(mA): 0.005; Input Type: CMOS/TTL; Bits(#): 8; Rating: Catalog; Voltage(Nom)(V): 3.3; Schmitt Trigger: No; Sub-Family: Dual Supply Translator; tpd @ Nom Voltage(Max)(ns): 4.9; PackageReference: VQFN-20; Supplier 1: Mouser; Supplier Part Number 1: 595-TXS0108ERGYR; Supplier 2: Digi-Key; Supplier Part Number 2: 296-24806-2-ND; Supplier 3: Digi-Key; Supplier Part Number 3: 296-24806-1-ND; Supplier 4: Digi-Key; Supplier Part Number 4: 296-24806-6-ND; Operating Temperature Range(C): -40 to 85; 3-State Output: No; PartNumber: TXS0108ERGYR; ComponentLink1Description: Manufacturer URL; ComponentLink1URL: http://www.ti.com/; ComponentLink2Description: Datasheet; ComponentLink2URL: http://www.ti.com/lit/ds/symlink/txs0108e.pdf
D7 = MT25QL512ABB1EW9-0SIT: 512 Mb (x1/x2/x4) Serial NOR Flash Memory with Multi I/O, 108 MHz, 2.7 to 3.6 V, 16-pin SO16 Wide (SF), Tape & Reel; Part Family: MT25Q; Manufacturer: Micron; Density: 512Mb; Speed: 133 MHz; Voltage: 2.7V-3.6V; DatasheetVersion: Rev. J; PackageReference: 8-WDFN; PackageDescription: 8-WPDFN (6x8) (MLP8); Applications: Embedded; Package: 8-WDFN Exposed Pad; Part Status: Production; RoHS: Yes; Type: Multi I/O; Width: x1/x2/x4; Mounting Technology: Surface Mount; PartNumber: MT25QL512ABB1EW9-0SIT; ComponentLink1Description: Manufacturer URL; ComponentLink1URL: http://www.micron.com/; ComponentLink2Description: Datasheet; ComponentLink2URL: https://www.micron.com/~/media/documents/products/data-sheet/nor-flash/serial-nor/mt25q/die-rev-b/mt25q_qlkt_l_512_abb_0.pdf; ComponentLink3Description: Package Specification; ComponentLink3URL: https://www.micron.com/~/media/documents/products/data-sheet/nor-flash/serial-nor/mt25q/die-rev-b/mt25q_qlkt_l_512_abb_0.pdf
R60 R61 R63 = CR0402-#-±5%: Чип резистор; Maximum Working Voltage: 50 В; TOLERANCE: 5%; Supplier 1: Digi-Key
  R60 R61: Supplier Part Number 1: 311-100JRTR-ND
  R63: Supplier Part Number 1: 311-10.0KJRTR-ND
R62 = CR0402-#-±5%: Чип резистор; Maximum Working Voltage: 50 В; TOLERANCE: 5%; VALUE: 0 Ом; Supplier 1: Digi-Key; Supplier Part Number 1: 311-10.0KLRDKR-ND